# Altium schematic sheet fpga.SchDoc (part 1 of 3)
size A0
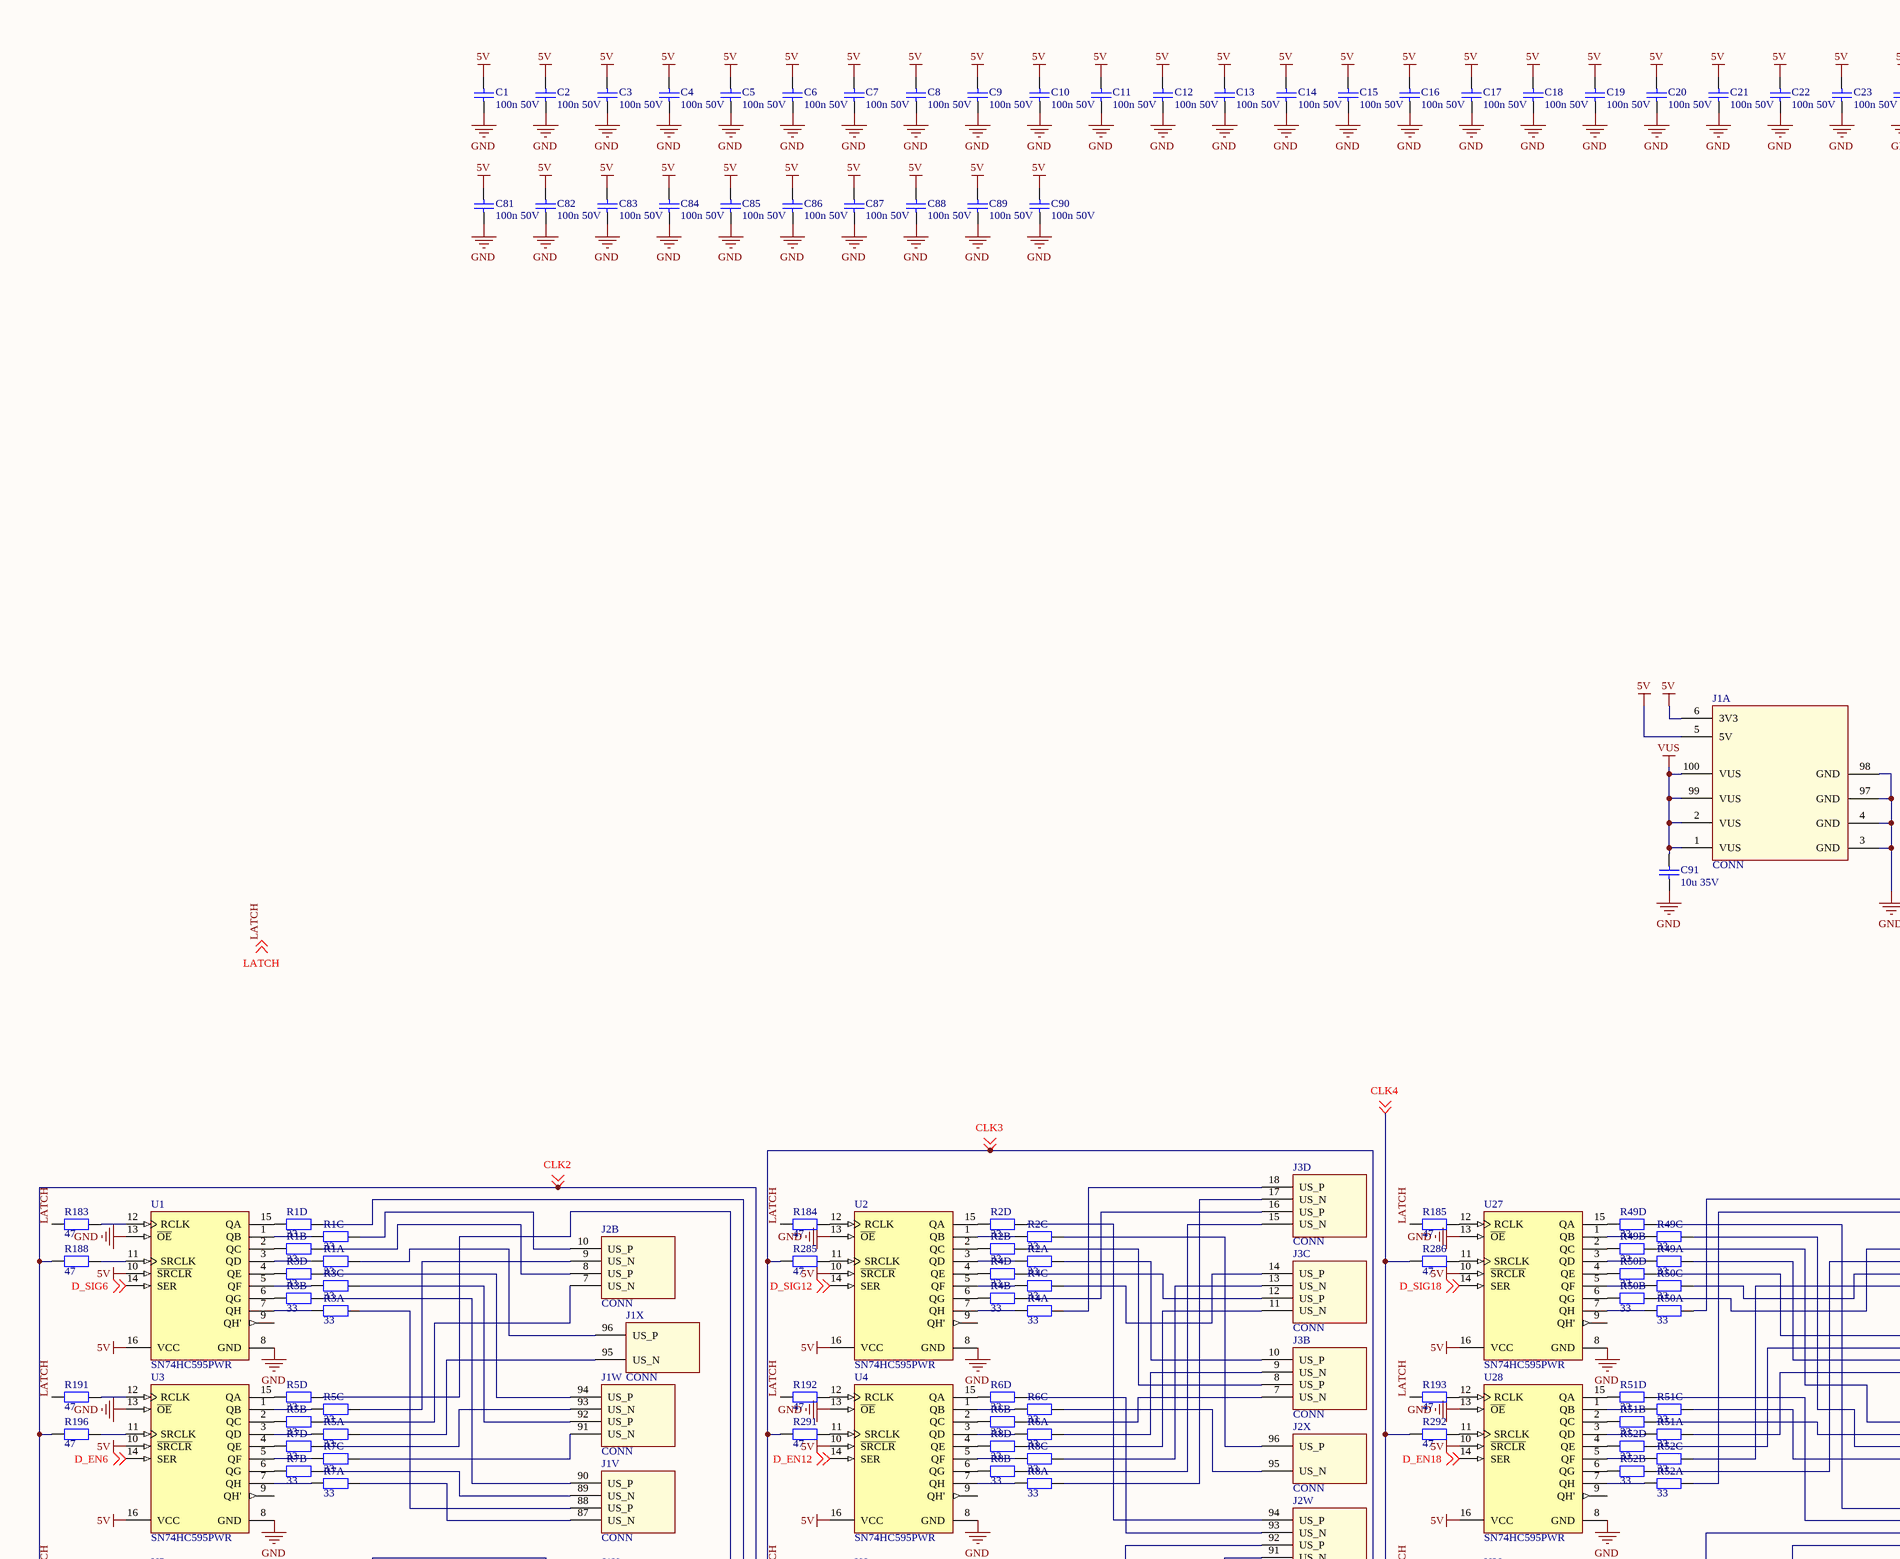
[diagram p0: fpga.SchDoc, top left]
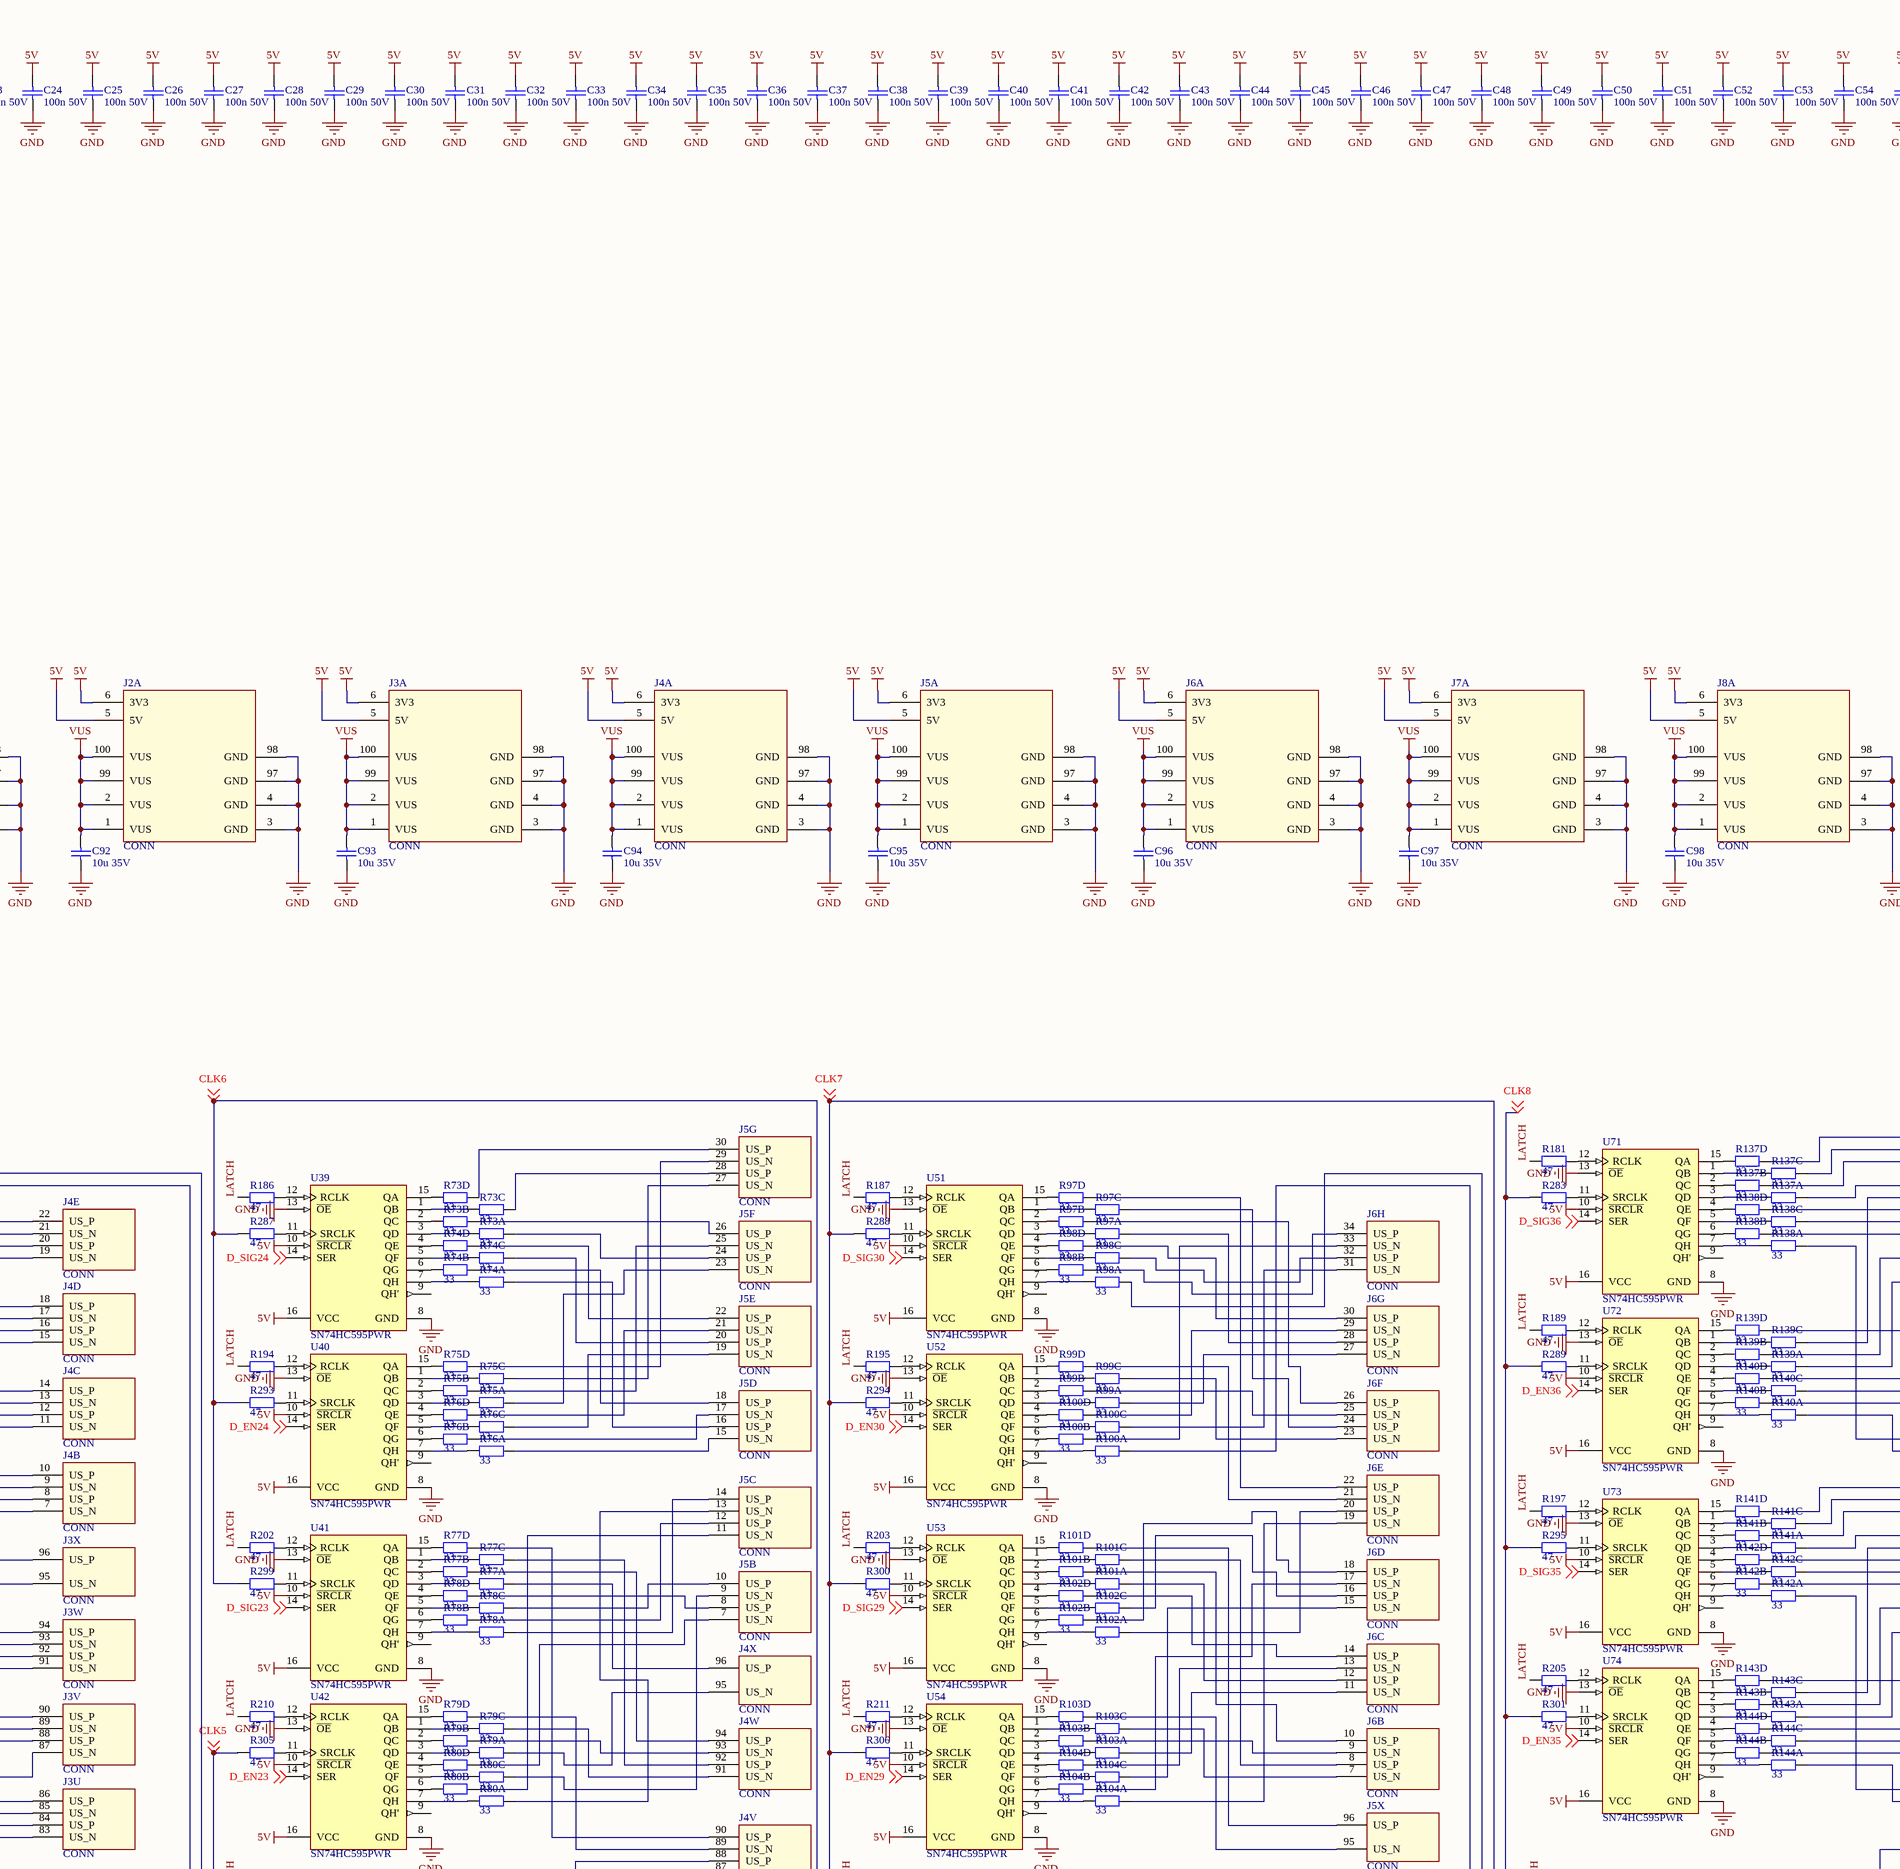
[diagram p1: fpga.SchDoc, top middle]
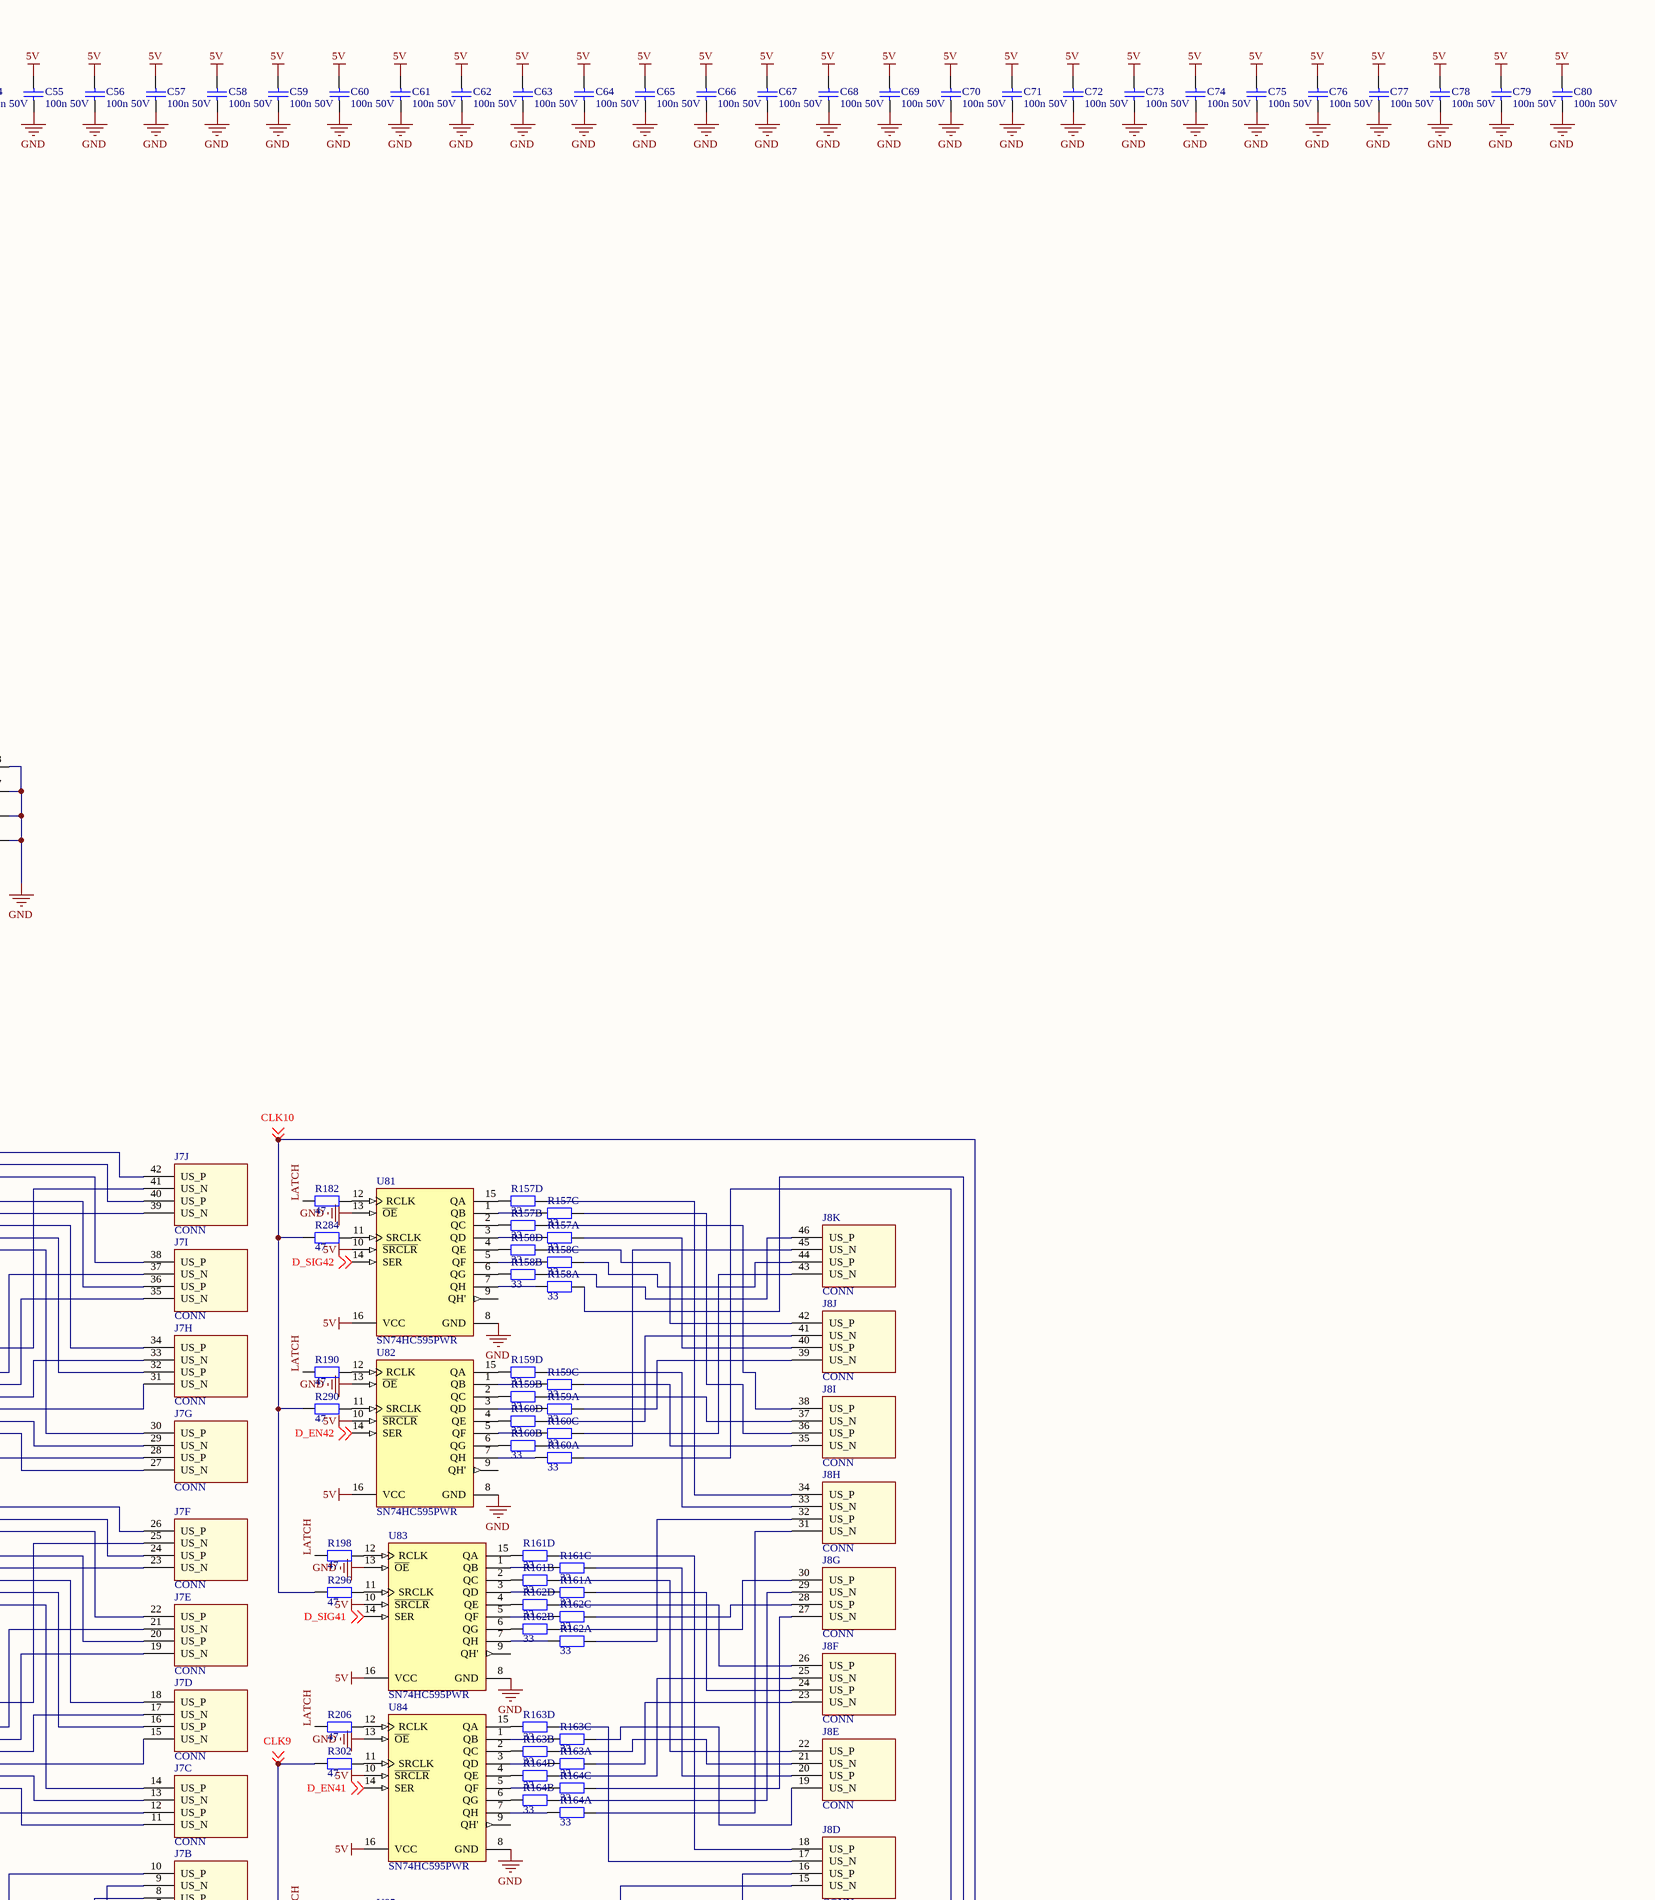
[diagram p2: fpga.SchDoc, top right]
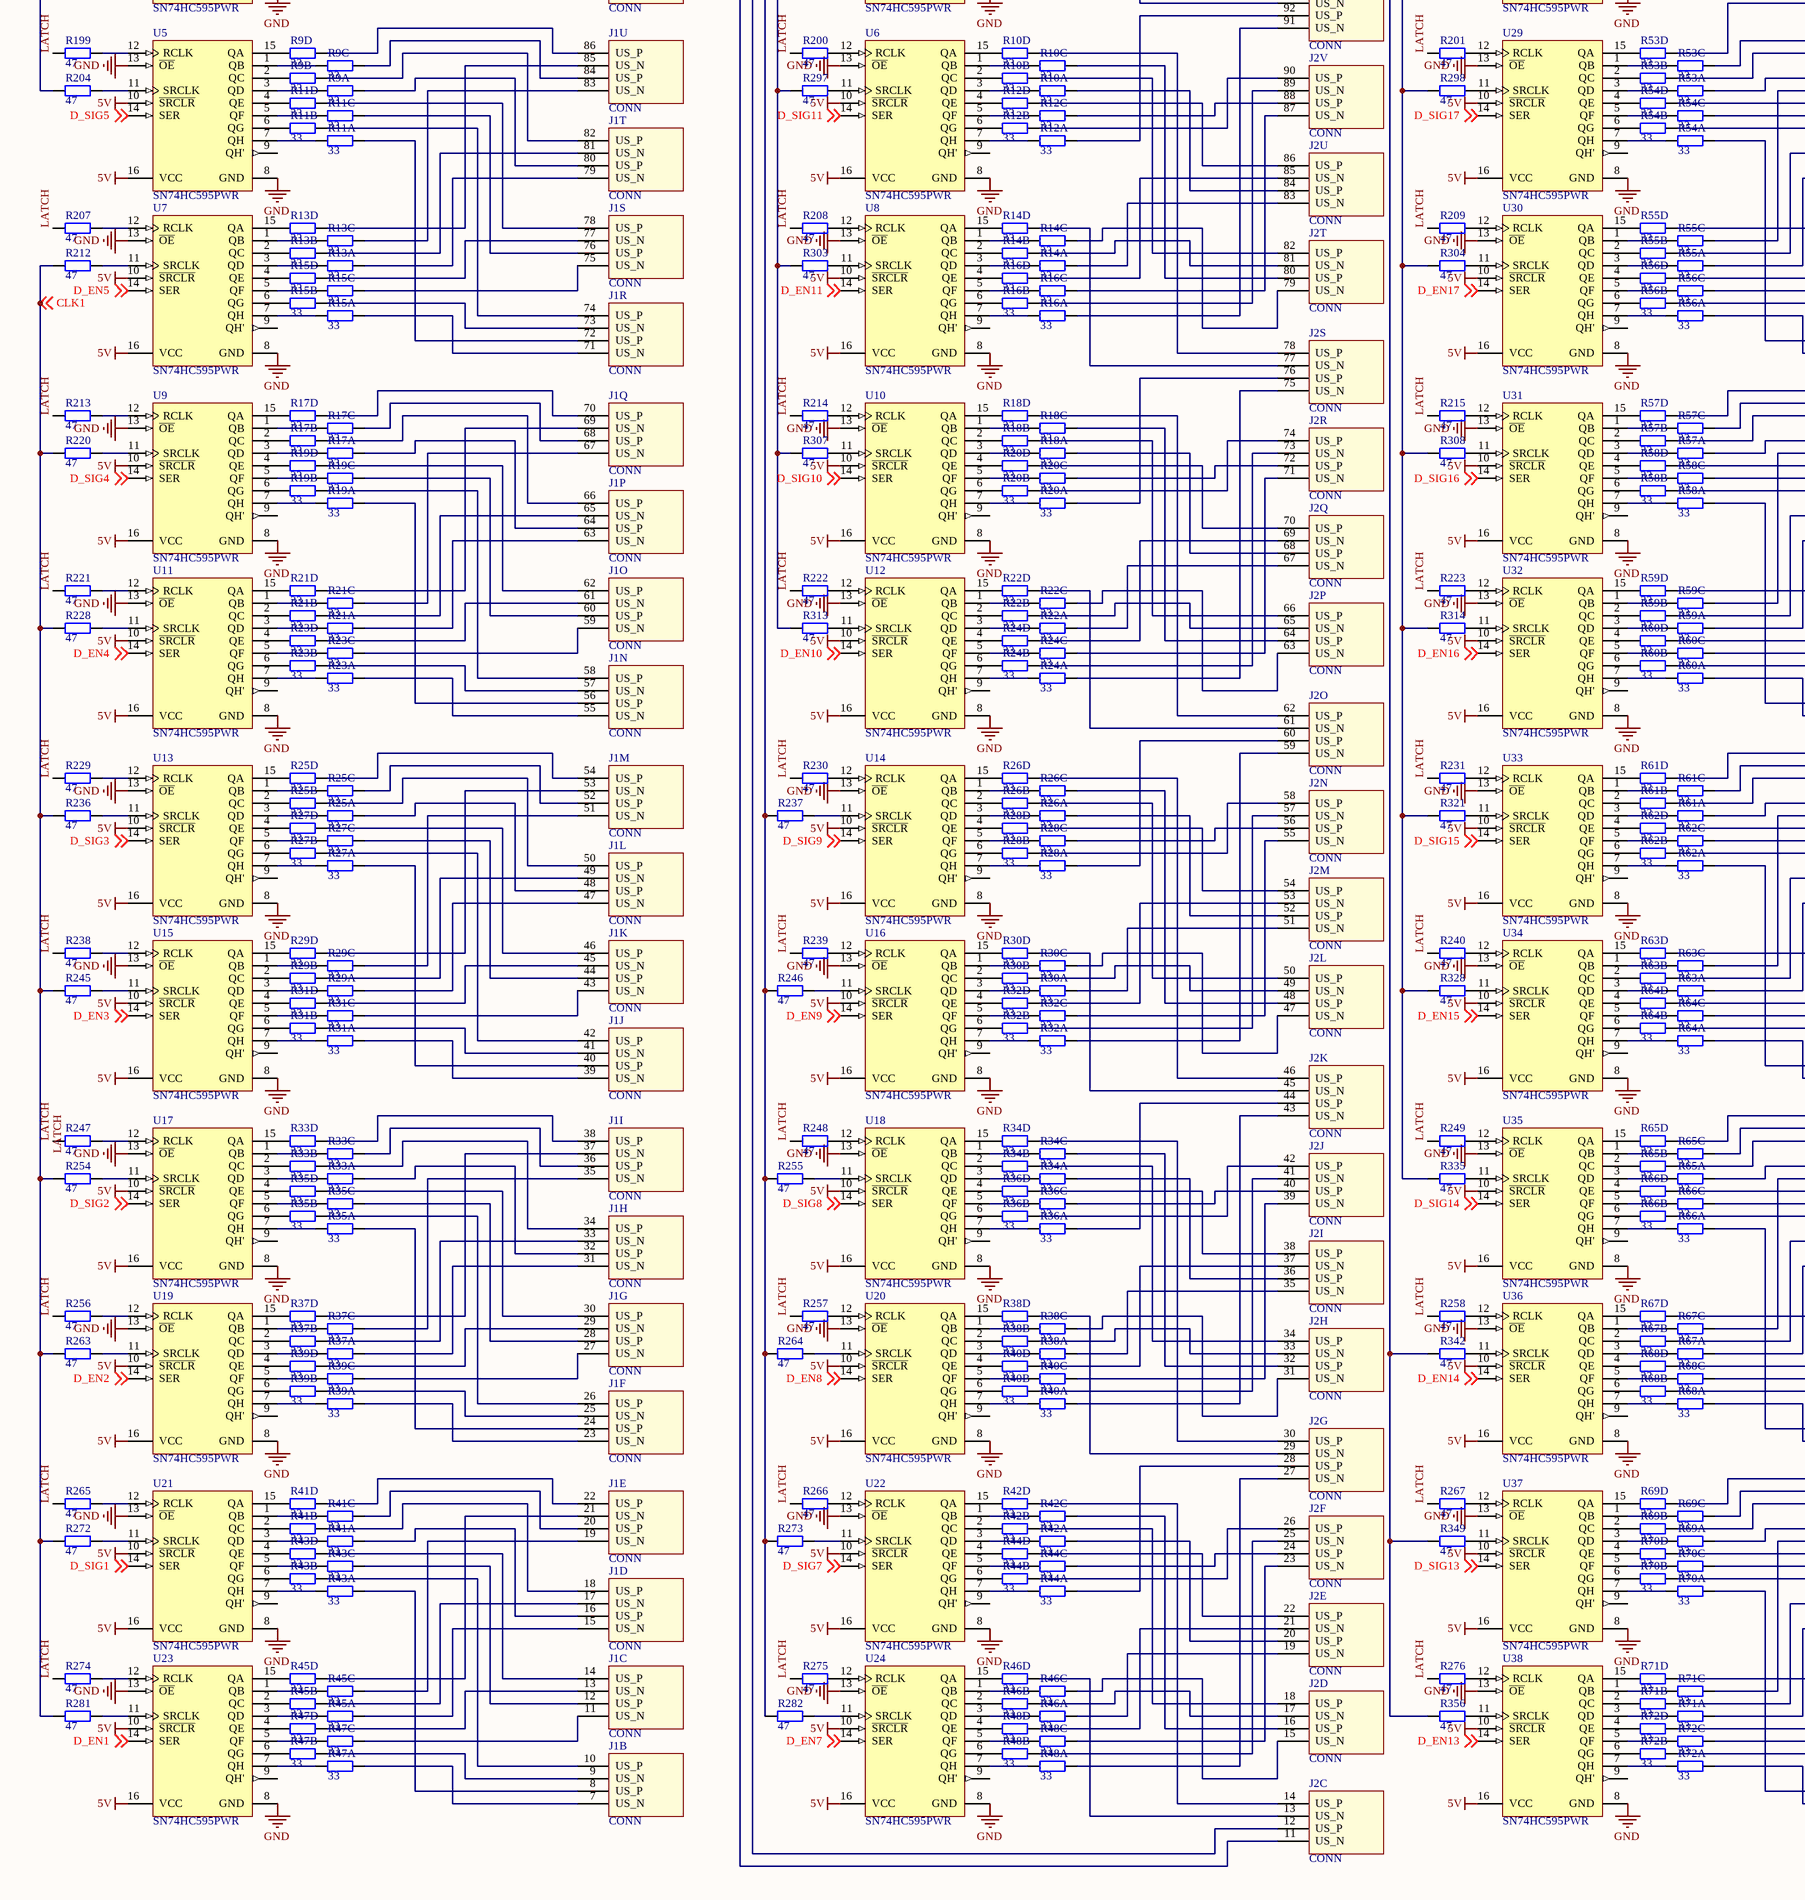
[diagram p3: fpga.SchDoc, bottom left]